# EasyEDA Pro project Cerberus_Sub_Controller_v01.eprj, schematic Cerberus_Sub_Controller_v01 (continued)
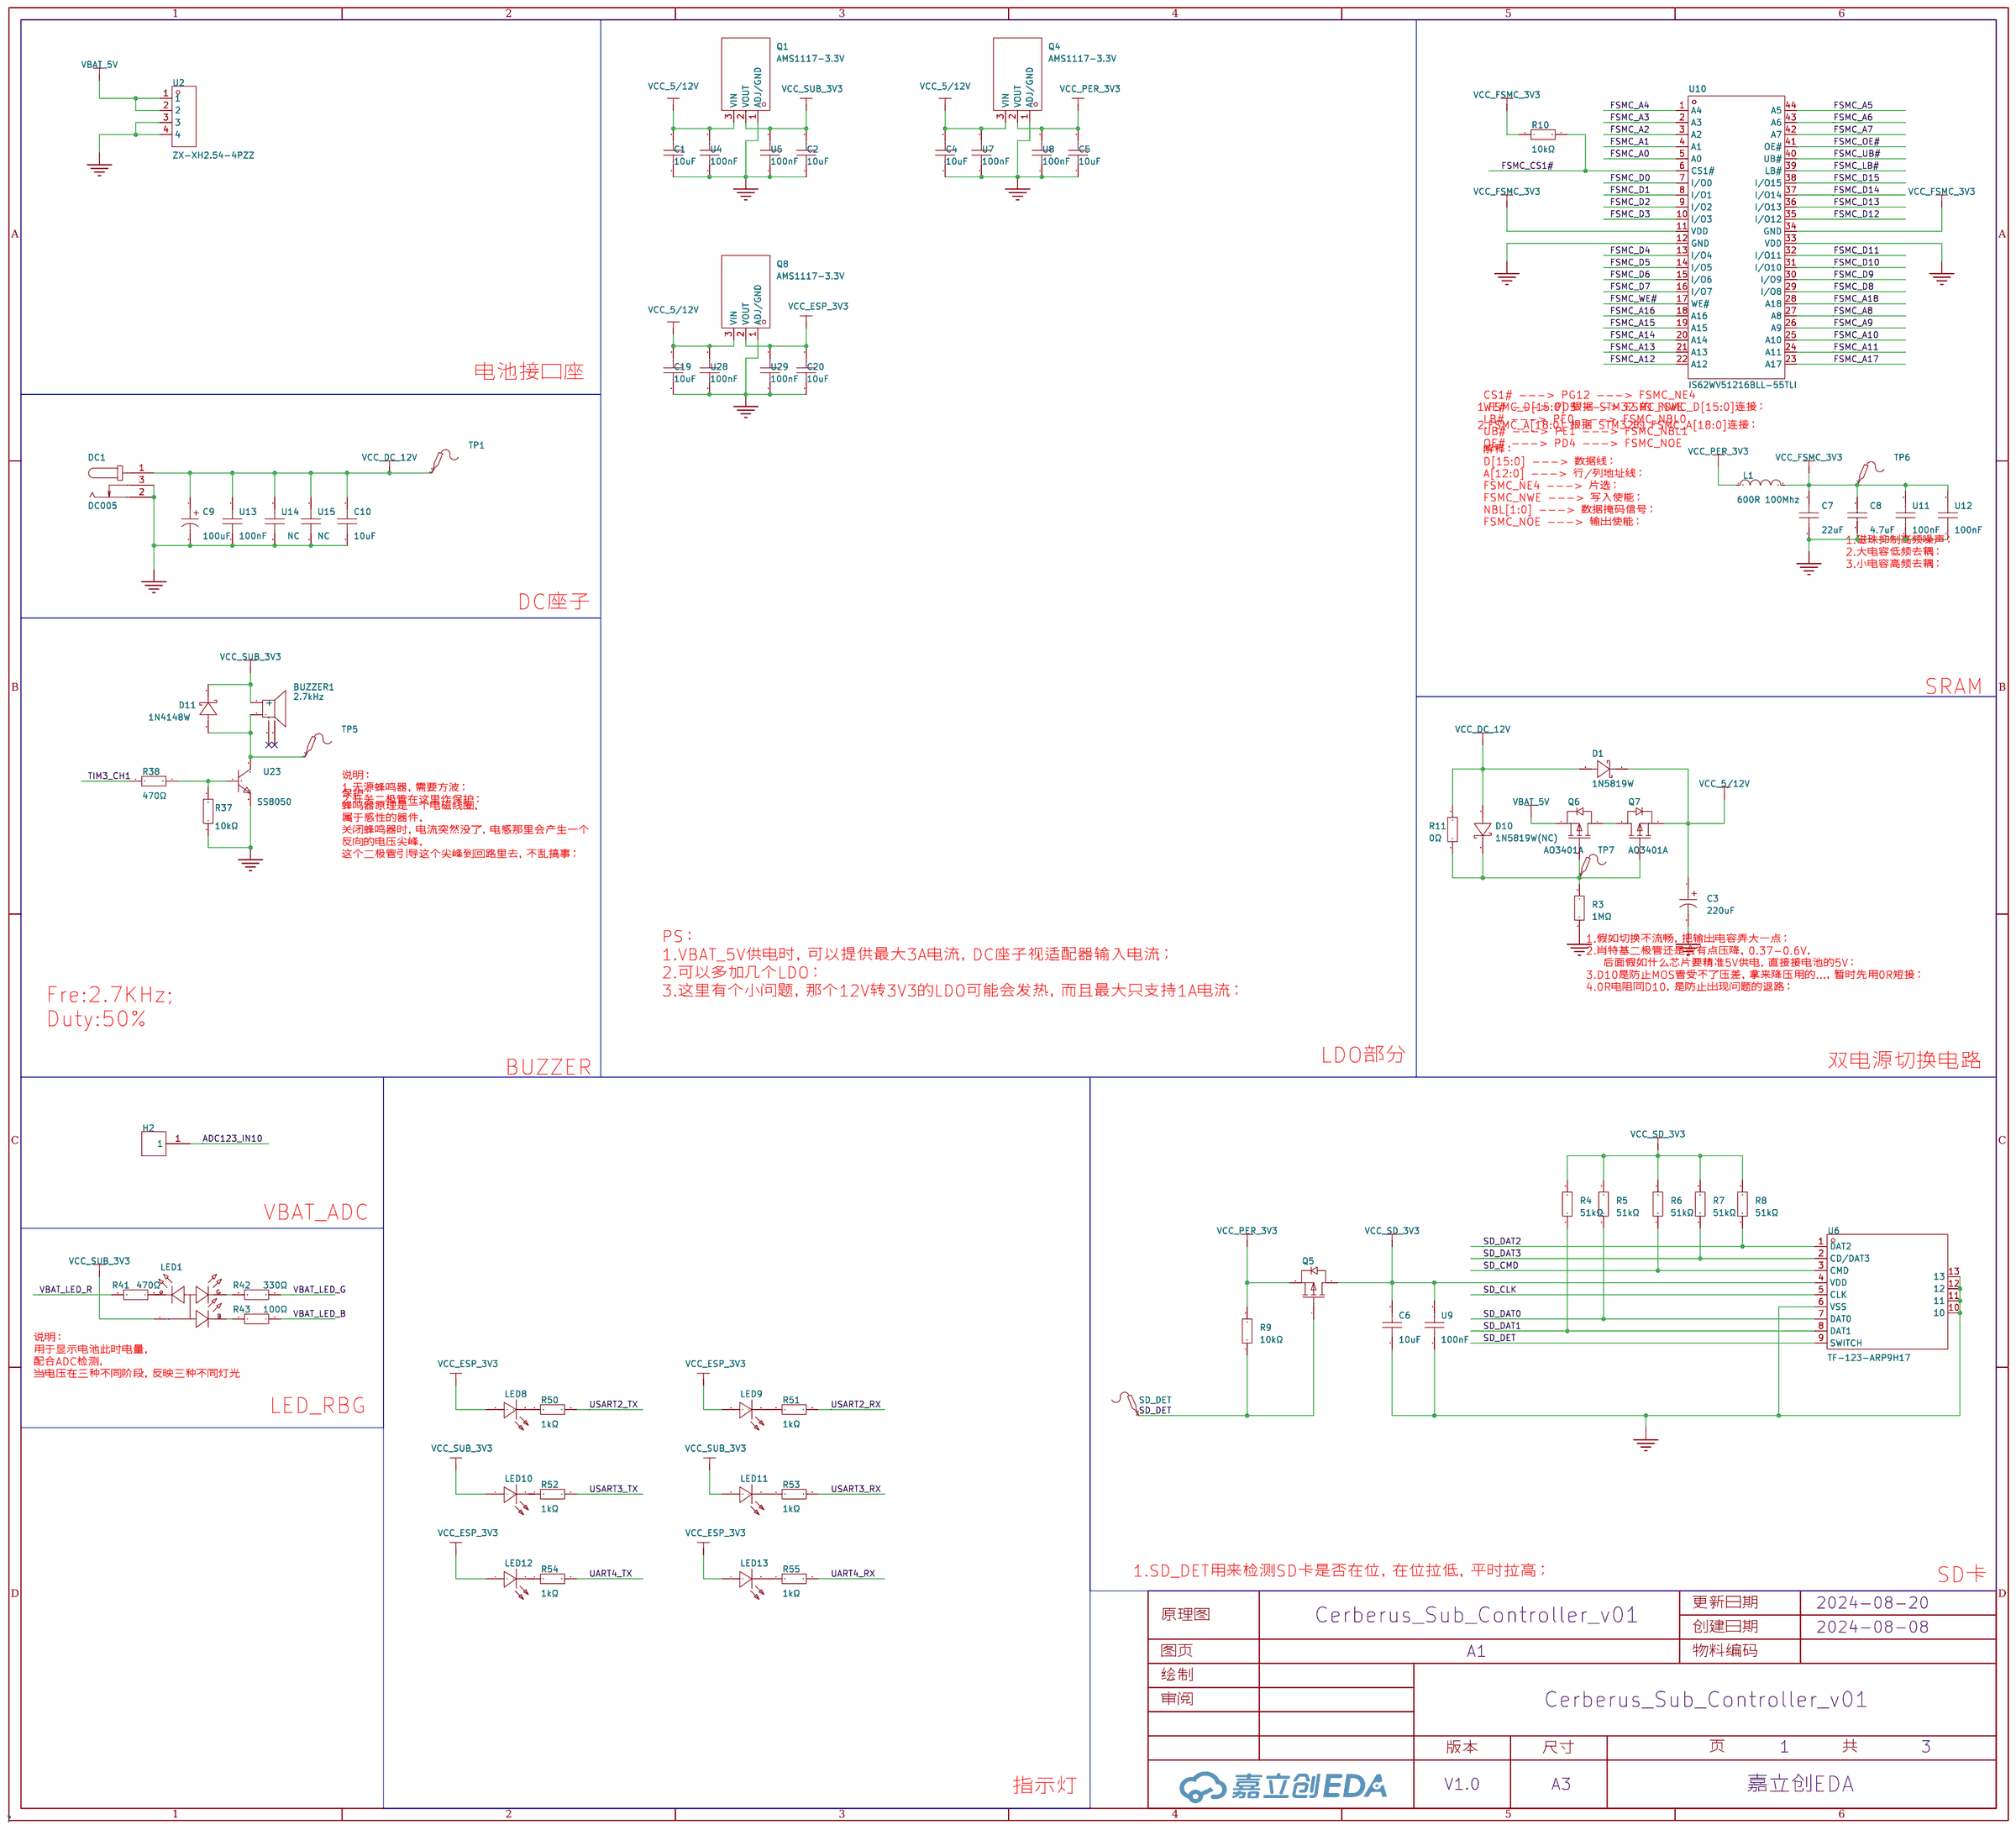
[diagram p0: A1]
## Library data of the parts (continued)
Q1 Q4 Q8 = AMS1117-3.3V_C5120796: 输出类型:固定;最大输入电压:18V;输出电压:3.3V;最大输出电流:1A;输出极性:正极;; LCSC Part Name: 输入18V 输出3.3V 1A; Supplier Part: C5120796; Manufacturer: MSKSEMI(美森科); Supplier Footprint: SOT-89; JLCPCB Part Class: 扩展库; Datasheet: https://atta.szlcsc.com/upload/public/pdf/source/20231123/6117526697EB8BF6175FDEEBA0877266.pdf; Supplier: LCSC; Output Type: 固定; Maximum Input Voltage: 18V; Output Voltage: 3.3V; MAX Output Current: 1A; Dropout Voltage: 1.4V@(1A); standby current: 12mA; Operating Temperature: 0℃~+125℃; Output Polarity: 正极; Number of Outputs: 1
Q5 = SI2305CDS-T1-GE3: 类型:1个P沟道;漏源电压(Vdss):8V;连续漏极电流(Id):5.8A;功率(Pd):960mW；1.7W;导通电阻(RDS(on)@Vgs,Id):35mΩ@4.5V,4.4A;阈值电压(Vgs(th)@Id):1V@250uA;; LCSC Part Name: 1个P沟道 耐压:8V 电流:5.8A; Supplier Part: C37577; Manufacturer: VISHAY(威世); Supplier Footprint: SOT-23; JLCPCB Part Class: 扩展库; Datasheet: https://atta.szlcsc.com/upload/public/pdf/source/20150319/1457707265783.pdf; Supplier: LCSC; Type: 1个P沟道; Drain Source Voltage (Vdss): 8V; Continuous Drain Current (Id): 5.8A; Power Dissipation (Pd): 960mW；1.7W; Drain Source On Resistance (RDS(on)@Vgs,Id): 35mΩ@4.5V,4.4A; Gate Threshold Voltage (Vgs(th)@Id): 1V@250uA; Total Gate Charge (Qg@Vgs): 30nC@8V; Input Capacitance (Ciss@Vds): 960pF@4V; Operating Temperature: -55℃~+150℃@(Tj)
Q6 Q7 = AO3401A_C15127: 类型:1个P沟道;漏源电压(Vdss):30V;连续漏极电流(Id):4A;功率(Pd):1.4W;导通电阻(RDS(on)@Vgs,Id):44mΩ@10V,4.3A;阈值电压(Vgs(th)@Id):1.3V@250uA;; LCSC Part Name: 1个P沟道 耐压:30V 电流:4A; Supplier Part: C15127; Manufacturer: AOS; Supplier Footprint: SOT-23; JLCPCB Part Class: 基础库; Datasheet: https://atta.szlcsc.com/upload/public/pdf/source/20160507/1462613609053.pdf; Supplier: LCSC; Type: 1个P沟道; Drain Source Voltage (Vdss): 30V; Continuous Drain Current (Id): 4A; Power Dissipation (Pd): 1.4W; Drain Source On Resistance (RDS(on)@Vgs,Id): 44mΩ@10V,4.3A; Gate Threshold Voltage (Vgs(th)@Id): 1.3V@250uA; Total Gate Charge (Qg@Vgs): 12.2nC@4.5V; Input Capacitance (Ciss@Vds): 1.2nF@15V; Operating Temperature: -55℃~+150℃@(Tj)
R3 = 0402WGF1004TCE: 电阻类型:厚膜电阻;阻值:1MΩ;精度:±1%;功率:62.5mW;最大工作电压:50V;温度系数:±100ppm/℃;; LCSC Part Name: 1MΩ ±1% 62.5mW 厚膜电阻; Supplier Part: C26083; Manufacturer: UNI-ROYAL(厚声); Supplier Footprint: 0402; JLCPCB Part Class: 基础库; Datasheet: https://atta.szlcsc.com/upload/public/pdf/source/20200306/C422600_1E6D84923E4A46A82E41ADD87F860B5C.pdf; Supplier: LCSC; Type: 厚膜电阻; Tolerance: ±1%; Power(Watts): 62.5mW; Overload Voltage (Max): 50V; Temperature Coefficient: ±100ppm/℃; Operating Temperature Range: -55℃~+155℃
R4-R8 = 0603WAF5102T5E: 电阻类型:厚膜电阻;阻值:51kΩ;精度:±1%;功率:100mW;最大工作电压:75V;温度系数:±100ppm/℃;; LCSC Part Name: 51kΩ ±1% 100mW 厚膜电阻; Supplier Part: C23196; Manufacturer: UNI-ROYAL(厚声); Supplier Footprint: 0603; JLCPCB Part Class: 基础库; Datasheet: https://atta.szlcsc.com/upload/public/pdf/source/20200306/C422600_1E6D84923E4A46A82E41ADD87F860B5C.pdf; Supplier: LCSC; Type: 厚膜电阻; Tolerance: ±1%; Power(Watts): 100mW; Overload Voltage (Max): 75V; Temperature Coefficient: ±100ppm/℃; Operating Temperature Range: -55℃~+155℃
R9 R10 R37 R39 R40 R57 R65 R66 R68 R69 = 0603WAF1002T5E: 电阻类型:厚膜电阻;阻值:10kΩ;精度:±1%;功率:100mW;最大工作电压:75V;温度系数:±100ppm/℃;; LCSC Part Name: 厚膜电阻 10kΩ ±1% 100mW; Supplier Part: C25804; Manufacturer: UNI-ROYAL(厚声); Supplier Footprint: 0603; JLCPCB Part Class: 基础库; Datasheet: https://atta.szlcsc.com/upload/public/pdf/source/20200306/C422600_1E6D84923E4A46A82E41ADD87F860B5C.pdf; Supplier: LCSC; Type: 厚膜电阻; Tolerance: ±1%; Power(Watts): 100mW; Overload Voltage (Max): 75V; Temperature Coefficient: ±100ppm/℃; Operating Temperature Range: -55℃~+155℃
R11 R29-R36 R60-R64 R67 = 0603WAF0000T5E: 电阻类型:厚膜电阻;阻值:0Ω;精度:±1%;功率:100mW;最大工作电压:75V;; LCSC Part Name: 0Ω ±1% 100mW 厚膜电阻; Supplier Part: C21189; Manufacturer: UNI-ROYAL(厚声); Supplier Footprint: 0603; JLCPCB Part Class: 基础库; Datasheet: https://atta.szlcsc.com/upload/public/pdf/source/20200306/C422600_1E6D84923E4A46A82E41ADD87F860B5C.pdf; Supplier: LCSC; Type: 厚膜电阻; Tolerance: ±1%; Power(Watts): 100mW; Overload Voltage (Max): 75V; Operating Temperature Range: -55℃~+155℃
R38 R41 = 0603WAF4700T5E: 电阻类型:厚膜电阻;阻值:470Ω;精度:±1%;功率:100mW;最大工作电压:75V;温度系数:±100ppm/℃;; LCSC Part Name: 470Ω ±1% 100mW 厚膜电阻; Supplier Part: C23179; Manufacturer: UNI-ROYAL(厚声); Supplier Footprint: 0603; JLCPCB Part Class: 基础库; Datasheet: https://atta.szlcsc.com/upload/public/pdf/source/20200306/C422600_1E6D84923E4A46A82E41ADD87F860B5C.pdf; Supplier: LCSC; Type: 厚膜电阻; Tolerance: ±1%; Power(Watts): 100mW; Overload Voltage (Max): 75V; Temperature Coefficient: ±100ppm/℃; Operating Temperature Range: -55℃~+155℃
R42 = 0603WAF3300T5E: 电阻类型:厚膜电阻;阻值:330Ω;精度:±1%;功率:100mW;最大工作电压:75V;温度系数:±100ppm/℃;; LCSC Part Name: 330Ω ±1% 100mW 厚膜电阻; Supplier Part: C23138; Manufacturer: UNI-ROYAL(厚声); Supplier Footprint: 0603; JLCPCB Part Class: 基础库; Datasheet: https://atta.szlcsc.com/upload/public/pdf/source/20200306/C422600_1E6D84923E4A46A82E41ADD87F860B5C.pdf; Supplier: LCSC; Type: 厚膜电阻; Tolerance: ±1%; Power(Watts): 100mW; Overload Voltage (Max): 75V; Temperature Coefficient: ±100ppm/℃; Operating Temperature Range: -55℃~+155℃
R43 = RC0603FR-07100RL: 电阻类型:厚膜电阻;阻值:100Ω;精度:±1%;功率:100mW;最大工作电压:75V;温度系数:±100ppm/℃;; LCSC Part Name: 厚膜电阻 100Ω ±1% 100mW; Supplier Part: C105588; Manufacturer: YAGEO(国巨); Supplier Footprint: 0603; JLCPCB Part Class: 扩展库; Datasheet: https://atta.szlcsc.com/upload/public/pdf/source/20180316/70C0E2BDAE7FCC62C531A5A58D202EE1.pdf; Supplier: LCSC; Type: 厚膜电阻; Tolerance: ±1%; Power(Watts): 100mW; Overload Voltage (Max): 75V; Temperature Coefficient: ±100ppm/℃; Operating Temperature Range: -55℃~+155℃
R26-R28 R50-R55 = RC0603FR-071KL: 电阻类型:厚膜电阻;阻值:1kΩ;精度:±1%;功率:100mW;最大工作电压:75V;温度系数:±100ppm/℃;; LCSC Part Name: 厚膜电阻 1kΩ ±1% 100mW; Supplier Part: C22548; Manufacturer: YAGEO(国巨); Supplier Footprint: 0603; JLCPCB Part Class: 扩展库; Datasheet: https://atta.szlcsc.com/upload/public/pdf/source/20180316/70C0E2BDAE7FCC62C531A5A58D202EE1.pdf; Supplier: LCSC; Type: 厚膜电阻; Tolerance: ±1%; Power(Watts): 100mW; Overload Voltage (Max): 75V; Temperature Coefficient: ±100ppm/℃; Operating Temperature Range: -55℃~+155℃
SD_DET TP1 TP5-TP10 = Test-Point: Test Point 测试点
U2 U22 = ZX-XH2.54-4PZZ: 插针结构:1x4P;间距:2.54mm;安装方式:直插;参考系列:XH;总PIN数:4P;排数:1;每排PIN数:4;行距:-;额定电流:3A;触头材质:黄铜;触头镀层:锡;工作温度范围:-25℃~+85℃;; Supplier Part: C7429634; Manufacturer: Megastar(兆星); Supplier Footprint: 插件,P=2.54mm; JLCPCB Part Class: 扩展库; Datasheet: https://atta.szlcsc.com/upload/public/pdf/source/20230619/B529A2163E0159A644AB3383D208FB03.pdf; Supplier: LCSC; Pins Structure: 1x4P; Pitch: 2.54mm; Mounting Style: 直插; Reference Series: XH; Number of Pins: 4P; Number of Rows: 1; Number of PINs Per Row: 4; Current Rating (Max): 3A; Contact Material: 黄铜; Contact Plating: 锡; Operating Temperature Range: -25℃~+85℃
U4 U5 U7-U9 U11-U15 U20 U21 U28 U29 = CGA0603X7R104K500JT: 容值:100nF;精度:±10%;额定电压:50V;材质(温度系数):X7R;; LCSC Part Name: 100nF ±10% 50V; Supplier Part: C6119867; Manufacturer: HRE(芯声); Supplier Footprint: 0603; JLCPCB Part Class: 扩展库; Supplier: LCSC; Tolerance: ±10%; Voltage Rated: 50V; Temperature Coefficient: X7R
U6 = TF-123-ARP9H17: 卡连接方式:拔插式;卡类型:MicroSD卡(TF卡);连接器类型:卡座;本体最大高度:1.7mm;触头材质:磷铜;触头镀层:金;工作温度范围:-25℃~+85℃;焊接温度(最大值):260℃;; LCSC Part Name: 拔插式 MicroSD卡(TF卡) 卡座; Supplier Part: C2982548; Manufacturer: XUNPU(讯普); Supplier Footprint: SMD; JLCPCB Part Class: 扩展库; Datasheet: https://atta.szlcsc.com/upload/public/pdf/source/20220311/12D4DAC699E408EFF19FAC6014C660FF.pdf; Supplier: LCSC; Card Connection Mode: 拔插式; Card Type: MicroSD卡(TF卡); Connector Type: 卡座; Maximum Body Height: 1.7mm; Contact Material: 磷铜; Contact Plating: 金; Operating Temperature Range: -25℃~+85℃; Soldering Temperature(Max): 260℃
U10 = IS62WV51216BLL-55TLI: 8-Mbit(512K × 16bit)，并行接口，工作电压：2.5V to 3.6V; Supplier Part: C11315; Manufacturer: ISSI(美国芯成); Supplier Footprint: TSOP-44-10.2mm; JLCPCB Part Class: 扩展库; Datasheet: https://atta.szlcsc.com/upload/public/pdf/source/20130225/1457706593006.pdf; Supplier: LCSC
U23 = SS8050_C7420370: 晶体管类型:NPN;集电极电流(Ic):1.5A;集射极击穿电压(Vceo):25V;功率(Pd):300mW;直流电流增益(hFE@Ic,Vce):120@100mA,1.0V;; LCSC Part Name: 耐压:25V 电流:1.5A NPN H档 200-350; Supplier Part: C7420370; Manufacturer: 宏迦橙; Supplier Footprint: SOT-23; JLCPCB Part Class: 扩展库; Datasheet: https://atta.szlcsc.com/upload/public/pdf/source/20231222/9C4050A7669EB24B3ACD0418218817FD.pdf; Supplier: LCSC; Transistor Type: NPN; Collector Current (Ic): 1.5A; Collector-Emitter Breakdown Voltage (Vceo): 25V; Power Dissipation (Pd): 300mW; DC Current Gain (hFE@Ic,Vce): 120@100mA,1.0V; Transition Frequency (fT): 100MHz; Collector Cut-Off Current (Icbo): 100nA; Collector-Emitter Saturation Voltage (VCE(sat)@Ic,Ib): 500mV@800mA,80mA; Operating Temperature: -55℃~+150℃
C11-C13 C16 C17 = GRM155R71H104KE14D: 容值:100nF;精度:±10%;额定电压:50V;材质(温度系数):X7R;; LCSC Part Name: 100nF ±10% 50V; Supplier Part: C77020; Manufacturer: muRata(村田); Supplier Footprint: 0402; JLCPCB Part Class: 扩展库; Datasheet: https://atta.szlcsc.com/upload/public/pdf/source/20180326/C77020_39BD49C951FF1AF0DB1F1FAC5AC1E401.pdf; Supplier: LCSC; Tolerance: ±10%; Voltage Rated: 50V; Temperature Coefficient: X7R
C14 = CC0402KRX7R9BB222: 容值:2.2nF;精度:±10%;额定电压:50V;材质(温度系数):X7R;; LCSC Part Name: 2.2nF ±10% 50V; Supplier Part: C106861; Manufacturer: YAGEO(国巨); Supplier Footprint: 0402; JLCPCB Part Class: 扩展库; Datasheet: https://atta.szlcsc.com/upload/public/pdf/source/20170505/1493957848374.pdf; Supplier: LCSC; Tolerance: ±10%; Voltage Rated: 50V; Temperature Coefficient: X7R
C15 = CL05A106MP5NUNC: 容值:10uF;精度:±20%;额定电压:10V;材质(温度系数):X5R;; LCSC Part Name: 10uF ±20% 10V; Supplier Part: C315248; Manufacturer: SAMSUNG(三星); Supplier Footprint: 0402; JLCPCB Part Class: 扩展库; Datasheet: https://atta.szlcsc.com/upload/public/pdf/source/20231220/1EF805BAE1520675928CC4638D279E74.pdf; Supplier: LCSC; Tolerance: ±20%; Voltage Rated: 10V; Temperature Coefficient: X5R
C18 = CL05B224KO5NNNC: 容值:220nF;精度:±10%;额定电压:16V;材质(温度系数):X7R;; LCSC Part Name: 220nF ±10% 16V; Supplier Part: C16772; Manufacturer: SAMSUNG(三星); Supplier Footprint: 0402; JLCPCB Part Class: 基础库; Datasheet: https://atta.szlcsc.com/upload/public/pdf/source/20160218/1457707763339.pdf; Supplier: LCSC; Tolerance: ±10%; Voltage Rated: 16V; Temperature Coefficient: X7R
C21 = CL10A106KP8NNNC: 容值:10uF;精度:±10%;额定电压:10V;材质(温度系数):X5R;; LCSC Part Name: 10uF ±10% 10V; Supplier Part: C19702; Manufacturer: SAMSUNG(三星); Supplier Footprint: 0603; JLCPCB Part Class: 基础库; Datasheet: https://atta.szlcsc.com/upload/public/pdf/source/20160218/1457707763339.pdf; Supplier: LCSC; Tolerance: ±10%; Voltage Rated: 10V; Temperature Coefficient: X5R
C22 = CC0603KRX7R9BB104: 容值:100nF;精度:±10%;额定电压:50V;材质(温度系数):X7R;; LCSC Part Name: 100nF ±10% 50V; Supplier Part: C14663; Manufacturer: YAGEO(国巨); Supplier Footprint: 0603; JLCPCB Part Class: 基础库; Datasheet: https://atta.szlcsc.com/upload/public/pdf/source/20180910/C282072_33301C7F631E79921B82A8DAC6BCC5B3.pdf; Supplier: LCSC; Tolerance: ±10%; Voltage Rated: 50V; Temperature Coefficient: X7R
C23 = CA45-B6R3K227T: 容值:220uF;精度:±10%;额定电压:6.3V;等效串联电阻:1.2Ω@100kHz;; LCSC Part Name: 220uF ±10% 6.3V; Supplier Part: C122649; Manufacturer: 湘怡中元/湘江; Supplier Footprint: CASE-B-3528; JLCPCB Part Class: 扩展库; Datasheet: https://atta.szlcsc.com/upload/public/pdf/source/20191009/C435293_78A410F3D73489DBEAC46056C4262F7A.pdf; Supplier: LCSC; Tolerance: ±10%; Rated Voltage: 6.3V; Equivalent Series Resistance(ESR): 1.2Ω@100kHz; Operating Temperature: -55℃~+125℃
CN3 = WAFER-SH1.0-6PWB: 插针结构:1x6P;间距:1mm;安装方式:卧贴;总PIN数:6P;排数:1;每排PIN数:6;额定电流:1A;工作温度范围:-25℃~+85℃;; LCSC Part Name: 1x6P 间距:1mm 卧贴; Supplier Part: C3029345; Manufacturer: XUNPU(讯普); Supplier Footprint: SMD,P=1mm,卧贴; JLCPCB Part Class: 扩展库; Datasheet: https://atta.szlcsc.com/upload/public/pdf/source/20220527/1879B8210BD3B2006BCEAC1A40D397B6.pdf; Supplier: LCSC; Pins Structure: 1x6P; Pitch: 1mm; Mounting Style: 卧贴; Number of Pins: 6P; Number of Rows: 1; Number of PINs Per Row: 6; Current Rating (Max): 1A; Operating Temperature Range: -25℃~+85℃
H7 = PZ254V-11-05P: 插针结构:1x5P;间距:2.54mm;行距:-;圆针/方针:方针;安装类型:直插;排数:单排;总PIN位数:5P;额定电流:-;额定电压:-;配合针长度:6mm;塑高:2.5mm;端接针长度:3mm;触头材质:黄铜;触头镀层:-;工作温度范围:-40℃~+105℃;颜色:黑色;; LCSC Part Name: 间距:2.54mm 1x5P 直插 方针; Supplier Part: C492404; Manufacturer: XFCN(兴飞); Supplier Footprint: 插件,P=2.54mm; JLCPCB Part Class: 扩展库; Datasheet: https://atta.szlcsc.com/upload/public/pdf/source/20200309/C492404_E51533260F8710EFF5D4617281164C1D.pdf; Supplier: LCSC; Pin Structure: 1x5P; Pitch: 2.54mm; Circluar Pins/Square Pins: 方针; Mounting Type: 直插; Number of Rows: 单排; Number of Pins: 5P; Length of Mating Pin: 6mm; Insulation Height: 2.5mm; Length of End Connection Pin: 3mm; Contact Material: 黄铜; Operating Temperature Range: -40℃~+105℃; Color: 黑色
H8 H9 = PZ254V-12-4P: 插针结构:2x2P;间距:2.54mm;行距:2.54mm;圆针/方针:方针;安装类型:直插;排数:双排;总PIN位数:4P;额定电流:-;额定电压:-;配合针长度:6mm;塑高:2.5mm;端接针长度:3mm;触头材质:黄铜;触头镀层:-;工作温度范围:-40℃~+105℃;颜色:黑色;; LCSC Part Name: 间距:2.54mm 2x2P 直插 方针; Supplier Part: C492419; Manufacturer: XFCN(兴飞); Supplier Footprint: 插件,P=2.54mm; JLCPCB Part Class: 扩展库; Datasheet: https://atta.szlcsc.com/upload/public/pdf/source/20200309/C492419_0001C06E73AFF21BD0ED3D7CEEF46D29.pdf; Supplier: LCSC; Pin Structure: 2x2P; Pitch: 2.54mm; Row Spacing: 2.54mm; Circluar Pins/Square Pins: 方针; Mounting Type: 直插; Number of Rows: 双排; Number of Pins: 4P; Length of Mating Pin: 6mm; Insulation Height: 2.5mm; Length of End Connection Pin: 3mm; Contact Material: 黄铜; Operating Temperature Range: -40℃~+105℃; Color: 黑色
H3-H6 H10 = PZ254V-11-03P: 插针结构:1x3P;间距:2.54mm;行距:-;圆针/方针:方针;安装类型:直插;排数:单排;总PIN位数:3P;额定电流:3A;额定电压:250V;配合针长度:6mm;塑高:2.5mm;端接针长度:3mm;工作温度范围:-40℃~+105℃;颜色:黑色;; LCSC Part Name: 间距:2.54mm 1x3P 直插 方针; Supplier Part: C2937625; Manufacturer: XFCN(兴飞); Supplier Footprint: 插件,P=2.54mm; JLCPCB Part Class: 扩展库; Datasheet: https://atta.szlcsc.com/upload/public/pdf/source/20200309/C492402_8335C3D49C4E4C618838D59BB1D024C1.pdf; Supplier: LCSC; Pin Structure: 1x3P; Pitch: 2.54mm; Circluar Pins/Square Pins: 方针; Mounting Type: 直插; Number of Rows: 单排; Number of Pins: 3P; Current Rating (Max): 3A; Voltage Rating (Max): 250V; Length of Mating Pin: 6mm; Insulation Height: 2.5mm; Length of End Connection Pin: 3mm; Operating Temperature Range: -40℃~+105℃; Color: 黑色
R1 R2 = 0603WAF5101T5E: 电阻类型:厚膜电阻;阻值:5.1kΩ;精度:±1%;功率:100mW;最大工作电压:75V;温度系数:±100ppm/℃;; LCSC Part Name: 5.1kΩ ±1% 100mW 厚膜电阻; Supplier Part: C23186; Manufacturer: UNI-ROYAL(厚声); Supplier Footprint: 0603; JLCPCB Part Class: 基础库; Datasheet: https://atta.szlcsc.com/upload/public/pdf/source/20200306/C422600_1E6D84923E4A46A82E41ADD87F860B5C.pdf; Supplier: LCSC; Type: 厚膜电阻; Tolerance: ±1%; Power(Watts): 100mW; Overload Voltage (Max): 75V; Temperature Coefficient: ±100ppm/℃; Operating Temperature Range: -55℃~+155℃
R12 = RC0402FR-0710KL: 电阻类型:厚膜电阻;阻值:10kΩ;精度:±1%;功率:62.5mW;最大工作电压:50V;温度系数:±100ppm/℃;; LCSC Part Name: 厚膜电阻 10kΩ ±1% 62.5mW; Supplier Part: C60490; Manufacturer: YAGEO(国巨); Supplier Footprint: 0402; JLCPCB Part Class: 扩展库; Datasheet: https://atta.szlcsc.com/upload/public/pdf/source/20170925/C131467_1506321478108990263.pdf; Supplier: LCSC; Type: 厚膜电阻; Tolerance: ±1%; Power(Watts): 62.5mW; Overload Voltage (Max): 50V; Temperature Coefficient: ±100ppm/℃; Operating Temperature Range: -55℃~+155℃
R13-R15 = 0402WGF1000TCE: 电阻类型:厚膜电阻;阻值:100Ω;精度:±1%;功率:62.5mW;最大工作电压:50V;温度系数:±200ppm/℃;; LCSC Part Name: 100Ω ±1% 62.5mW 厚膜电阻; Supplier Part: C25076; Manufacturer: UNI-ROYAL(厚声); Supplier Footprint: 0402; JLCPCB Part Class: 基础库; Datasheet: https://atta.szlcsc.com/upload/public/pdf/source/20200306/C422600_1E6D84923E4A46A82E41ADD87F860B5C.pdf; Supplier: LCSC; Type: 厚膜电阻; Tolerance: ±1%; Power(Watts): 62.5mW; Overload Voltage (Max): 50V; Temperature Coefficient: ±200ppm/℃; Operating Temperature Range: -55℃~+155℃
R16 R17 = 0603WAF4701T5E: 电阻类型:厚膜电阻;阻值:4.7kΩ;精度:±1%;功率:100mW;最大工作电压:75V;温度系数:±100ppm/℃;; LCSC Part Name: 4.7kΩ ±1% 100mW 厚膜电阻; Supplier Part: C23162; Manufacturer: UNI-ROYAL(厚声); Supplier Footprint: 0603; JLCPCB Part Class: 基础库; Datasheet: https://atta.szlcsc.com/upload/public/pdf/source/20200306/C422600_1E6D84923E4A46A82E41ADD87F860B5C.pdf; Supplier: LCSC; Type: 厚膜电阻; Tolerance: ±1%; Power(Watts): 100mW; Overload Voltage (Max): 75V; Temperature Coefficient: ±100ppm/℃; Operating Temperature Range: -55℃~+155℃
R18-R21 = 0402WGF0000TCE: 电阻类型:厚膜电阻;阻值:0Ω;精度:±1%;功率:62.5mW;最大工作电压:50V;温度系数:±800ppm/℃;; LCSC Part Name: 0Ω ±1% 62.5mW 厚膜电阻; Supplier Part: C17168; Manufacturer: UNI-ROYAL(厚声); Supplier Footprint: 0402; JLCPCB Part Class: 基础库; Datasheet: https://atta.szlcsc.com/upload/public/pdf/source/20200306/C422600_1E6D84923E4A46A82E41ADD87F860B5C.pdf; Supplier: LCSC; Type: 厚膜电阻; Tolerance: ±1%; Power(Watts): 62.5mW; Overload Voltage (Max): 50V; Temperature Coefficient: ±800ppm/℃; Operating Temperature Range: -55℃~+155℃
R22-R25 = 0402WGJ0472TCE: 电阻类型:厚膜电阻;阻值:4.7kΩ;精度:±5%;功率:62.5mW;最大工作电压:50V;温度系数:±100ppm/℃;; LCSC Part Name: 4.7kΩ ±5% 62.5mW 厚膜电阻; Supplier Part: C25940; Manufacturer: UNI-ROYAL(厚声); Supplier Footprint: 0402; JLCPCB Part Class: 扩展库; Datasheet: https://atta.szlcsc.com/upload/public/pdf/source/20200306/C422600_1E6D84923E4A46A82E41ADD87F860B5C.pdf; Supplier: LCSC; Type: 厚膜电阻; Tolerance: ±5%; Power(Watts): 62.5mW; Overload Voltage (Max): 50V; Temperature Coefficient: ±100ppm/℃; Operating Temperature Range: -55℃~+155℃
SW1 SW2 = TS-1009S-04526: 电路结构:单刀单掷;按钮形状:圆形按钮;安装方式:立贴;开关长度:4.5mm;开关宽度:4.5mm;开关高度:4.5mm;触点电流:50mA;额定电压(DC):12V;带灯:-;机械寿命:-;; LCSC Part Name: 4.5*4.5*4.5mm 立贴 轻触开关; Supplier Part: C455245; Manufacturer: XUNPU(讯普); Supplier Footprint: SMD,4.5x4.5mm; JLCPCB Part Class: 扩展库; Datasheet: https://atta.szlcsc.com/upload/public/pdf/source/20191118/C455248_D35D7E271EC7BD44939E7F982BCB1632.pdf; Supplier: LCSC; Circuit: 单刀单掷; Actuator Style: 圆形按钮; Mounting Style: 立贴; Switch Length: 4.5mm; Switch Width: 4.5mm; Switch Height: 4.5mm; Contact Current: 50mA; Voltage Rating (DC): 12V
U1 = CH340N: LCSC Part Name: USB转串口芯片 CH340; Supplier Part: C2977777; Manufacturer: WCH(南京沁恒); Supplier Footprint: SOP-8; JLCPCB Part Class: 扩展库; Datasheet: https://atta.szlcsc.com/upload/public/pdf/source/20230530/6E401E9554E9F5311886CC8B3F89B62E.pdf; Supplier: LCSC
U16 = MPU-6050: 传感器类型:加速度计陀螺仪;; Supplier Part: C24112; Manufacturer: TDK InvenSense(应美盛); Supplier Footprint: QFN-24-EP(4x4); JLCPCB Part Class: 扩展库; Datasheet: https://atta.szlcsc.com/upload/public/pdf/source/20140425/1457707046159.pdf; Supplier: LCSC; Sensor Type: 加速度计陀螺仪; Operating Temperature: -40℃~+85℃
U17 = LIS2MDLTR: 磁传感器、数字输出、50高斯磁场动态范围、超低功耗、高性能、3轴磁力计; LCSC Part Name: 霍尔效应开关; Supplier Part: C919695; Manufacturer: ST(意法半导体); Supplier Footprint: LGA-12(2x2); JLCPCB Part Class: 扩展库; Datasheet: https://atta.szlcsc.com/upload/public/pdf/source/20211119/145E3A73C2A09E2C981D93C27CF540FA.pdf; Supplier: LCSC
U30 = ESP-12F(ESP8266MOD): 核心处理器:ESP8266芯片;频率:2.4GHz;天线形式:板载PCB天线;发射功率:16dBm;接收灵敏度:-90dBm;; LCSC Part Name: 完整的802.11b/g/nWi-FiSoC模块; Supplier Part: C82891; Manufacturer: Ai-Thinker(安信可); Supplier Footprint: SMD,16x24mm; JLCPCB Part Class: 扩展库; Datasheet: https://atta.szlcsc.com/upload/public/pdf/source/20210219/C82891_ABD84A460F4F056A2757267CCCA4B508.pdf; Supplier: LCSC; Core Processor: ESP8266芯片; Support Interface: GPIO；UART；I2C；PWM；SPI；ADC; Antenna Type: 板载PCB天线; Output Power: 16dBm; Operating Voltage: 3.3V; Receive  Current: 120mA; Send  Current: 170mA; Sensitivity: -90dBm; Operating Temperature: -40℃~+85℃
USB1 = TYPE-C 16PIN 2MD(073): 连接器类型:Type-C;标准:-;公母:母;端口数量:1;触点数量:16P;安装方式:卧贴;额定电流 - 电源:5A;工作温度范围:-25℃~+85℃;; LCSC Part Name: Type-C 母 卧贴; Supplier Part: C2765186; Manufacturer: SHOU HAN(首韩); Supplier Footprint: SMD; JLCPCB Part Class: 扩展库; Datasheet: https://atta.szlcsc.com/upload/public/pdf/source/20211123/39B17C16241EAC15C5E277BDA434118E.pdf; Supplier: LCSC; Connector Type: Type-C; Gender: 母; Number of Ports: 1; Number of Contacts: 16P; Mounting Style: 卧贴; Current Rating - Power (Max): 5A; Operating Temperature Range: -25℃~+85℃
CN1 CN2 = X0802WVS-60AS-LPV01: PIN总数:60P;间距:0.8mm;公母:公;安装方式:立贴;行数:2;额定电流:500mA;工作温度范围:-25℃~+85℃;; LCSC Part Name: 间距:0.8mm PIN:60P 公 立贴; Supplier Part: C2925331; Manufacturer: XKB Connection(中国星坤); Supplier Footprint: SMD,P=0.8mm; JLCPCB Part Class: 扩展库; Datasheet: https://atta.szlcsc.com/upload/public/pdf/source/20211215/082FD9024D3D5655771ED54599ED55C7.pdf; Supplier: LCSC; Number of Pins: 60P; Pitch: 0.8mm; Gender: 公; Mounting Style: 立贴; Number of Rows: 2; Current Rating (Max): 500mA; Operating Temperature Range: -25℃~+85℃
CN4 = ZX-XH2.54-2PZZ: 插针结构:1x2P;间距:2.54mm;安装方式:直插;参考系列:XH;总PIN数:2P;排数:1;每排PIN数:2;行距:-;额定电流:3A;触头材质:黄铜;触头镀层:锡;工作温度范围:-25℃~+85℃;; Supplier Part: C7429632; Manufacturer: Megastar(兆星); Supplier Footprint: 插件,P=2.54mm; JLCPCB Part Class: 扩展库; Datasheet: https://atta.szlcsc.com/upload/public/pdf/source/20230619/19BA6947230AA44A04D3EDD65E618FD0.pdf; Supplier: LCSC; Pins Structure: 1x2P; Pitch: 2.54mm; Mounting Style: 直插; Reference Series: XH; Number of Pins: 2P; Number of Rows: 1; Number of PINs Per Row: 2; Current Rating (Max): 3A; Contact Material: 黄铜; Contact Plating: 锡; Operating Temperature Range: -25℃~+85℃
U24 U25 = X6511WV-30H-C60D30: 插针结构:1x30P;间距:2.54mm;行距:2.54mm;圆针/方针:方针;安装类型:-;排数:单排;总PIN位数:30P;额定电流:3A;额定电压:250V;配合针长度:-;塑高:2.5mm;端接针长度:-;触头材质:黄铜;触头镀层:金;工作温度范围:-40℃~+105℃;焊接温度(最大值):260℃;颜色:黑色;; LCSC Part Name: 1x30P 间距:2.54mm 方针; Supplier Part: C2883689; Manufacturer: XKB Connection(中国星坤); Supplier Footprint: 插件,P=2.54mm; JLCPCB Part Class: 扩展库; Supplier: LCSC; Pin Structure: 1x30P; Pitch: 2.54mm; Row Spacing: 2.54mm; Circluar Pins/Square Pins: 方针; Number of Rows: 单排; Number of Pins: 30P; Current Rating (Max): 3A; Voltage Rating (Max): 250V; Insulation Height: 2.5mm; Contact Material: 黄铜; Contact Plating: 金; Operating Temperature Range: -40℃~+105℃; Soldering Temperature(Max): 260℃; Color: 黑色

## Nets
GND: C1.1 C2.1 C3.2 C4.1 C5.1 C6.1 C7.1 C8.1 C9.2 C10.1 C11.1 C12.1 C13.2 C14.2 C15.1 C16.2 C17.2 C18.1 C19.1 C20.1 C21.1 C22.1 C23.2 CN2.1 CN2.2 CN2.3 CN2.4 CN3.2 CN3.7 CN3.8 DC1.2 DC1.3 H3.1 H4.1 H5.1 H6.1 H10.3 Q1.1(ADJ/GND) Q4.1(ADJ/GND) Q8.1(ADJ/GND) R1.2 R2.2 R3.1 R12.1 R23.1 R25.1 R29.1 R37.1 R40.1 R66.1 R69.1 U1.3(GND) U2.3 U2.4 U4.1 U5.1 U6.6(VSS) U6.10 U6.11 U6.12 U6.13 U7.1 U8.1 U9.1 U10.12(GND) U10.33(VDD) U11.1 U12.1 U13.1 U14.1 U15.1 U16.1(CLKIN) U16.11(FSYNC) U16.18(GND) U16.25(EP) U17.6(GND) U17.8(GND) U20.1 U21.1 U22.4 U23.2(E) U25.1 U25.2 U25.3 U25.4 U25.5 U25.6 U25.7 U25.27 U25.28 U25.29 U25.30 U28.1 U29.1 U30.9(GND) USB1.1(GND) USB1.12(GND) USB1.13(SHELL) USB1.14(SHELL)
VBAT: CN1.11 CN1.12 U24.25
VBAT_5V: Q6.2(S) U2.1 U2.2
VCC_5/12V: C1.2 C3.1 C4.2 C19.2 D1.2(C) Q1.3(VIN) Q4.3(VIN) Q7.2(S) Q8.3(VIN) U4.2 U7.2 U22.1 U28.2
VCC_DC_12V: C9.1 C10.2 D1.1(A) D10.1(A) DC1.1 R11.2 TP1.1 U13.2 U14.2 U15.2
VCC_ESP_3V3: C20.2 C21.2 C22.2 LED8.1(+) LED9.1(+) LED12.1(+) LED13.1(+) Q8.2(VOUT) R57.1 R65.2 R68.2 U29.2 U30.8(VCC)
VCC_FSMC_3V3: C7.2 C8.2 L1.2 R10.1 TP6.1 U10.11(VDD) U10.34(GND) U11.2 U12.2
VCC_PER_3V3: C5.2 C15.2 C16.1 C17.1 C23.1 CN3.1 L1.1 Q4.2(VOUT) Q5.2(S) R9.2 R24.2 R26.2 R27.2 R28.2 U8.2 U17.9(Vdd) U17.10(Vdd_IO)
VCC_SD_3V3: C6.2 Q5.3(D) R4.2 R5.2 R6.2 R7.2 R8.2 U6.4(VDD) U9.2
VCC_SUB_3V3: BUZZER1.1(+) C2.2 C12.2 C13.1 CN1.1 CN1.2 CN1.3 D11.2(K) LED1.1(COM+) LED10.1(+) LED11.1(+) Q1.2(VOUT) R16.2 R17.2 R22.2 R39.2 U1.5(VCC) U1.8(V3) U5.2 U16.8(VLOGIC) U16.13(VDD) U20.2 U21.2 U24.26 U24.27 U24.28 U24.29 U24.30
ADC123_IN10: CN2.55 H2.1
D+: U1.1(UD+) USB1.6(DP1) USB1.8(DP2)
D-: U1.2(UD-) USB1.5(DN2) USB1.7(DN1)
ESP_ADC: H7.2 U30.2(ADC)
ESP_IO0: R65.1 SW1.1 U30.12(GPIO0)
ESP_IO2: H7.3 TP9.1 U30.11(GPIO2)
ESP_IO4: H7.4 U30.13(GPIO4)
ESP_IO5: H7.5 TP10.1 U30.14(GPIO5)
ESP_IO16: H7.1 U30.4(GPIO16)
ESP_RST: R68.1 SW2.1 U30.1(RST)
ESP_RX0: R61.1 U30.15(RXD0)
ESP_RX0_E: H9.4 H10.2
ESP_SPI_CLK: R62.1 U30.5(GPIO14)
ESP_SPI_CS: R67.1 U30.10(GPIO15)
ESP_SPI_MISO: R63.1 U30.6(GPIO12)
ESP_SPI_MOSI: R64.1 U30.7(GPIO13)
ESP_TX0: R60.1 U30.16(TXD0)
ESP_TX0_E: H8.4 H10.1
FSMC_A0: CN1.9 U10.5(A0)
FSMC_A1: CN1.8 U10.4(A1)
FSMC_A2: CN1.7 U10.3(A2)
FSMC_A3: CN1.6 U10.2(A3)
FSMC_A4: CN1.5 U10.1(A4)
FSMC_A5: CN1.4 U10.44(A5)
FSMC_A6: CN2.38 U10.43(A6)
FSMC_A7: CN2.37 U10.42(A7)
FSMC_A8: CN2.36 U10.27(A8)
FSMC_A9: CN2.35 U10.26(A9)
FSMC_A10: CN2.34 U10.25(A10)
FSMC_A11: CN2.33 U10.24(A11)
FSMC_A12: CN2.9 U10.22(A12)
FSMC_A13: CN2.8 U10.21(A13)
FSMC_A14: CN2.7 U10.20(A14)
FSMC_A15: CN2.6 U10.19(A15)
FSMC_A16: CN2.14 U10.18(A16)
FSMC_A17: CN2.13 U10.23(A17)
FSMC_A18: CN2.12 U10.28(A18)
FSMC_CS1#: CN1.31 R10.2 U10.6(CS1#)
FSMC_D0: CN2.11 U10.7(I/O0)
FSMC_D1: CN2.10 U10.8(I/O1)
FSMC_D2: CN1.42 U10.9(I/O2)
FSMC_D3: CN1.41 U10.10(I/O3)
FSMC_D4: CN2.32 U10.13(I/O4)
FSMC_D5: CN2.31 U10.14(I/O5)
FSMC_D6: CN2.30 U10.15(I/O6)
FSMC_D7: CN2.29 U10.16(I/O7)
FSMC_D8: CN2.28 U10.29(I/O8)
FSMC_D9: CN2.27 U10.30(I/O9)
FSMC_D10: CN2.26 U10.31(I/O10)
FSMC_D11: CN2.25 U10.32(I/O11)
FSMC_D12: CN2.24 U10.35(I/O12)
FSMC_D13: CN2.17 U10.36(I/O13)
FSMC_D14: CN2.16 U10.37(I/O14)
FSMC_D15: CN2.15 U10.38(I/O15)
FSMC_LB#: CN1.20 U10.39(LB#)
FSMC_OE#: CN1.38 U10.41(OE#)
FSMC_UB#: CN1.19 U10.40(UB#)
FSMC_WE#: CN1.37 U10.17(WE#)
I2C1_SCL: CN1.22 CN4.2 R15.2 R17.1 R20.2
I2C1_SDA: CN1.21 CN4.1 R14.2 R16.1 R21.2
LC02_CS: CN2.21 R32.1
LC02_CS_R: CN3.5 R28.1 R29.2 R32.2
LC02_RXD: CN3.4 R27.1 R31.2
LC02_TXD: CN3.3 R26.1 R30.2
LIS_CS: R22.1 R23.2 U17.3(CS)
LIS_INT: CN2.44 R24.1 R25.2 R63.2 U17.7(INT/DRDY/SDO)
LIS_SCL: R18.1 R20.1 U17.1(SCL/SPC)
LIS_SDA: R19.1 R21.1 U17.4(SDA/SDI/SDO)
MPU6050_AUX_CL: R18.2 U16.7(AUX_CL)
MPU6050_AUX_DA: R19.2 U16.6(AUX_DA)
MPU6050_INT: CN2.56 R13.1 TP8.1
PA0: CN2.50 H6.3 R35.1 R54.2
PA1: CN2.49 H6.2 R36.1 R55.2
PA2: CN2.48 H4.3 H9.2 R50.2
PA3: CN2.47 H4.2 H8.2 R51.2
PA4: CN2.46 U25.12
PA5: CN2.45 U25.21
PA7: CN2.43 U25.22
PA8: CN1.53 U24.18
PA9: CN1.52 H3.3 R34.1
PA10: CN1.51 H3.2 R33.1
PA11: CN1.50 U24.4
PA12: CN1.49 R67.2
PA15: CN1.46 U24.6
PB0: CN2.40 U25.14
PB1: CN2.39 U25.24
PB3: CN1.27 R62.2
PB4: CN1.26 U24.12
PB5: CN1.25 R64.2
PB6: CN1.24 U24.13
PB7: CN1.23 R41.1
PB10: CN2.23 H5.3 R31.1 R52.2
PB11: CN2.22 H5.2 R30.1 R53.2
PB13: CN2.20 U25.15
PB14: CN2.19 U25.25
PB15: CN2.18 U25.16
PC1: CN2.54 U25.10
PC2: CN2.53 U25.19
PC3: CN2.52 U25.11
PC4: CN2.42 U25.13
PC5: CN2.41 U25.23
PC6: CN1.57 R38.1
PC7: CN1.56 U24.3
PC8: CN1.55 R5.1 U6.7(DAT0)
PC9: CN1.54 R4.1 U6.8(DAT1)
PC10: CN1.45 R8.1 U6.1(DAT2)
PC11: CN1.44 R7.1 U6.2(CD/DAT3)
PC12: CN1.43 U6.5(CLK)
PC13: CN1.10 U24.16
PD2: CN1.40 R6.1 U6.3(CMD)
PD3: CN1.39 U24.20
PD6: CN1.36 U24.7
PD7: CN1.35 U24.21
PDR_ON: CN1.18 R39.1 R40.2
PE2: CN1.17 U24.22
PE3: CN1.16 U24.14
PE4: CN1.15 U24.23
PE5: CN1.14 U24.15
PE6: CN1.13 U24.24
PF6: CN2.60 U25.8
PF7: CN2.59 U25.17
PF8: CN2.58 U25.9
PF9: CN2.57 U25.18
PF11: CN2.5 U25.26
PG6: CN1.60 U24.1
PG7: CN1.59 U24.17
PG8: CN1.58 U24.2
PG9: CN1.34 U24.8
PG10: CN1.33 R42.2
PG11: CN1.32 U24.9
PG13: CN1.30 U24.10
PG14: CN1.29 R43.2
PG15: CN1.28 U24.11
SD_DET: Q5.1(G) R9.1 SD_DET.1 U6.9(SWITCH)
SWCLK: CN1.47 U24.19
SWDIO: CN1.48 U24.5
VREF+: CN2.51 U25.20
$1N508: Q6.3(D) Q7.3(D)
$1N11843: R37.2 R38.2 U23.1(B)
$2N431: R2.1 USB1.4(CC1)
$2N434: R1.1 USB1.10(CC2)
$2N1990: R12.2 U16.9(AD0)
$2N2067: C11.2 U16.10(REGOUT)
$2N2156: R13.2 U16.12(INT)
$2N2359: C14.1 U16.20(CPOUT)
$2N2438: R14.1 U16.24(SDA)
$2N2441: R15.1 U16.23(SCL)
$2N3213: C18.2 U17.5(C1)
$2N5650: R33.2 U1.6(TXD)
$2N5692: R34.2 U1.7(RXD)
$2N7761: R57.2 U30.3(EN)
$2N9578: H8.1 H8.3 R60.2
$2N9587: H9.1 H9.3 R61.2
Net-(BUZZER1-2): BUZZER1.2 D11.1(A) TP5.1 U23.3(C)
Net-(D10-2): D10.2(C) Q6.1(G) Q7.1(G) R3.2 R11.1 TP7.1
Net-(LED1-2): LED1.2(-) R41.2
Net-(LED1-3): LED1.3(-) R42.1
Net-(LED1-4): LED1.4(-) R43.1
Net-(LED8-2): LED8.2(-) R50.1
Net-(LED9-2): LED9.2(-) R51.1
Net-(LED10-2): LED10.2(-) R52.1
Net-(LED11-2): LED11.2(-) R53.1
Net-(LED12-2): LED12.2(-) R54.1
Net-(LED13-2): LED13.2(-) R55.1
Net-(R35-2): R35.2 U22.2
Net-(R36-2): R36.2 U22.3
Net-(R66-2): R66.2 SW1.4
Net-(R69-2): R69.2 SW2.4

Not connected (* = marked no-connect by the designer): BUZZER1 3* 4*; CN3 6*; SW1 2* 3*; SW2 2* 3*; U1 4(RTS#)*; U16 2(NC)* 3(NC)* 4(NC)* 5(NC)* 14(NC)* 15(NC)* 16(NC)* 17(NC)* 19(RESV)* 21(RESV)* 22(RESV)*; U17 2(NC)* 11(NC)* 12(NC)*; U30 17(CS0)* 18(MISO)* 19(GPIO9)* 20(GPIO10)* 21(MOSI)* 22(SCLK)*; USB1 2(VBUS)* 3(SBU2)* 9(SBU1)* 11(VBUS)*

## Notes on the sheets
sheet 1
- 电池接口座
- 1.FSMC_D[15:0] 根据 STM32 的 FSMC_D[15:0]连接；
- 2.FSMC_A[18:0] 根据 STM32的 FSMC_A[18:0]连接；
- CS1# ---> PG12 ---> FSMC_NE4
  WE# ---> PD5 ---> FSMC_NWE
  LB# ---> PE0 ---> FSMC_NBL0
  UB# ---> PE1 ---> FSMC_NBL1
  OE# ---> PD4 ---> FSMC_NOE
- 解释：
  D[15:0] ---> 数据线；
  A[12:0] ---> 行/列地址线；
  FSMC_NE4 ---> 片选；
  FSMC_NWE ---> 写入使能；
  NBL[1:0] ---> 数据掩码信号；
  FSMC_NOE ---> 输出使能；
- 1.磁珠抑制高频噪声；
  2.大电容低频去耦；
  3.小电容高频去耦；
- DC座子
- SRAM
- 说明：
  1.无源蜂鸣器，需要方波；
  2.开关二极管在这里作保护；
- 保护：
  蜂鸣器原理是一个电磁线圈，
  属于感性的器件，
  关闭蜂鸣器时，电流突然没了，电感那里会产生一个
  反向的电压尖峰，
  这个二极管引导这个尖峰到回路里去，不乱搞事；
- PS：
  1.VBAT_5V供电时，可以提供最大3A电流，DC座子视适配器输入电流；
  2.可以多加几个LDO；
  3.这里有个小问题，那个12V转3V3的LDO可能会发热，而且最大只支持1A电流；
- 1.假如切换不流畅，把输出电容弄大一点；
  2.肖特基二极管还是会有点压降，0.37-0.6V，
     后面假如什么芯片要精准5V供电，直接接电池的5V；
  3.D10是防止MOS管受不了压差，拿来降压用的...，暂时先用0R短接；
  4.0R电阻同D10，是防止出现问题的退路；
- Fre:2.7KHz;
  Duty:50%
- LDO部分
- BUZZER
- 双电源切换电路
- VBAT_ADC
- 说明：
  用于显示电池此时电量，
  配合ADC检测，
  当电压在三种不同阶段，反映三种不同灯光
- LED_RBG
- 1.SD_DET用来检测SD卡是否在位，在位拉低，平时拉高；
- SD卡
- 指示灯
sheet 2
- CH340 USB转串口
- Type-C座子
- 解释：
  VLOGIC ---> IO口电平；
  AD0 ---> 低位地址；
  REGOUT ---> 接稳压电容；
  FSYNC ---> 同步数字帧，不用就接地；
  INT ---> 输出中断；
- 说明：
  1.TX 与 RX 那个 0R 电阻是为了提高容错性；
  2.CS是片选信号，低电平有效；
  3.根据 2 可知，CS_R平时拉低，
     若要复用串口，把0R电阻去掉，焊接1K电阻，和到GPIO的0R；
- 说明：
  预留Openmv4接口；
  其中 openmv4 基于 立创开源 的 M。大佬的四层板；
  对其 MICRO-USB进行修改，换成XH2.54座子；
- I2C地址：0XD0
- TF-LC02 激光雷达模块
- OPENMV4
- MPU6050 陀螺仪+加速度计
- Vdd_IO 给一个100nF的；
  Vdd 靠近引脚给一个100nf，再来一个10uf；
- 说明：
  IO0拉低时，进入下载模式；
  TX0，RX0平时接STM32串口，
  需要外部调试时，可以用跳线帽接外部串口；
- 蓝牙与WIFI
- I2C默认地址：0x1E
- 1.那两根I2C先默认连接到MPU6050，看下能不能调得通，调不通用0R电阻再换到 I2C1 总线上去；
  2.CS 选择 I2C/SPI ，上拉I2C，接地SPI；
  3.LIS_INT 寄存器修改功能，PA6的SPI1_MISO ，也可以复用成GPIO；
  4.I2C支持 100KHz/400KHz/1MHz/3.4MHz；
- LIS2MDLTR 磁力计
sheet 3
- USART1 ---> USB_TypeC
- TIM3_CH1 ---> BUZZER
- USART2 ---> ESP12F
- USART3 ---> TF-LC02
- USRT4 ---> OPENMV4
- USART
- PWM
- I2C1 ---> MPU6050;
          ---> LIS2MDLTR;
          ---> PCA9685;
- ADC123_IN10 ---> VBAT
- 主控
- ADC
- SPI1 ---> ESP12F
- I2C
- FSMC ---> RAM
- 说明：
  USART1可以烧录，
  其它串口可以拿来调试芯片；
- FSMC
- 引出串口
- SPI
- PB12 ---> LC02_CS 控制 激光雷达使能
- PF10 ---> MPU6050_INT 输出中断
- PB5 ---> VBAT_LED_G
  PB7 ---> VBAT_LED_R
  PG14 ---> VBAT_LED_B
- 高电平时，掉电复位；
  低电平时，不会
- PDR
- 驱动PCA9685
- 引出多余的口
- GPIO
